# EasyEDA Pro project ProPrj_Smart business cardb_2026-04-14.epro

# Schematic Schematic1
Board Name: Board1; Create Date: 2026-01-03; Page Name: P1; Project Name: Smart business cardb; Schematic Name: Schematic1; Update Date: 2026-01-03; Company: EasyEDA.com; Page Size: A4; Version: V1.0
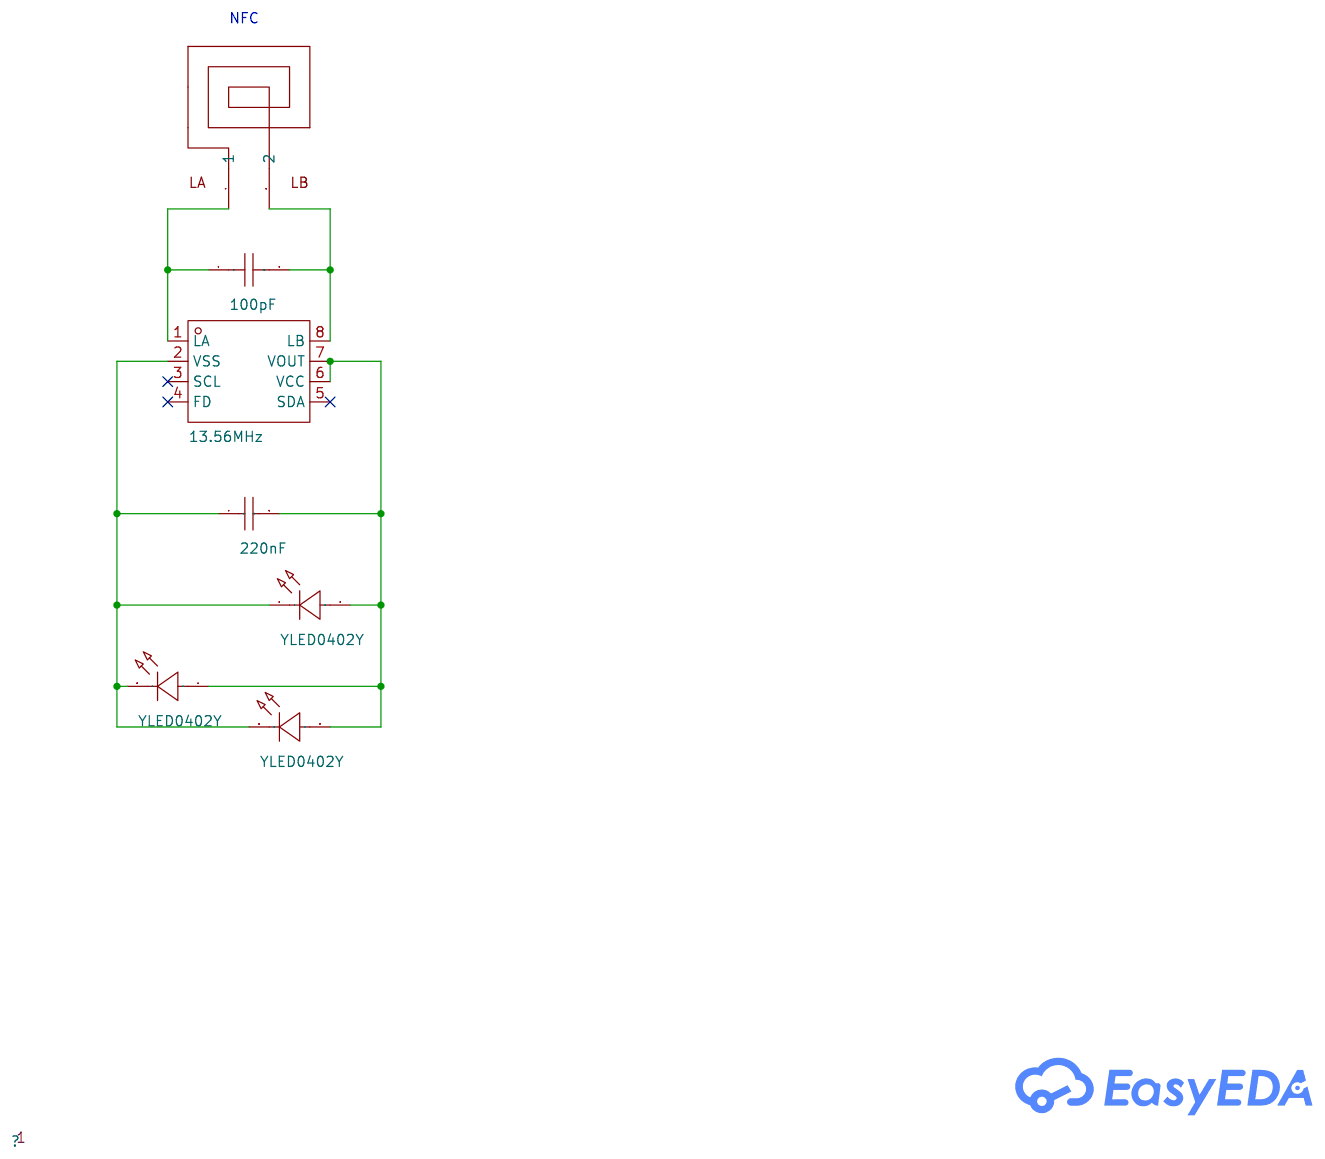
[diagram p0: schematic sheet]

## Parts
C1  220nF  [C0603]
C2  100pF  [C0603]
LED1  YLED0402Y  [LED0402-R-RD]
LED2  YLED0402Y  [LED0402-R-RD]
LED3  YLED0402Y  [LED0402-R-RD]
U3  13.56MHz  [TSSOP-8_L3.0-W3.0-P0.65-LS4.9-BL]
U4  U4  [NFC_ant]

## Library data of the parts
C1 = CL10B224KB8NNNC: Capacitance:220nF Tolerance:±10% Tolerance:±10% Voltage Rating:50V Temperature Coefficient:X7R; LCSC Part Name: 220nF ±10% 50V; Supplier Part: C64705; Manufacturer: SAMSUNG(三星); Supplier Footprint: 0603; JLCPCB Part Class: Extended Part; Datasheet: https://item.szlcsc.com/datasheet/CL10B224KB8NNNC/65773.html; Supplier: LCSC; Tolerance: ±10%; Voltage Rating: 50V; Temperature Coefficient: X7R
C2 = CC0603JRNPO9BN101: Capacitance:100pF Tolerance:±5% Tolerance:±5% Voltage Rating:50V Temperature Coefficient:NP0; LCSC Part Name: 100pF ±5% 50V; Supplier Part: C14665; Manufacturer: YAGEO(国巨); Supplier Footprint: 0603; JLCPCB Part Class: Extended Part; Datasheet: https://item.szlcsc.com/datasheet/CC0603JRNPO9BN101/15333.html; Supplier: LCSC; Tolerance: ±5%; Voltage Rating: 50V; Temperature Coefficient: NP0
LED1-LED3 = YLED0402Y: LCSC Part Name: 发光管; Supplier Part: C20608782; Manufacturer: YONGYUTAI(永裕泰); Supplier Footprint: 0402; JLCPCB Part Class: Extended Part; Datasheet: https://atta.szlcsc.com/upload/public/pdf/source/20240119/E1996C4BAD90A29F1F2A68BBFD6A1841.pdf; Supplier: LCSC
U3 = NT3H2211W0FTTJ: agreement:ISO 14443 interface type:I2C Frequency:13.56MHz Frequency:13.56MHz mains input:3.3V mains input:3.3V; Supplier Part: C2654822; Manufacturer: NXP(恩智浦); Supplier Footprint: TSSOP-8-3mm; JLCPCB Part Class: Extended Part; Datasheet: https://atta.szlcsc.com/upload/public/pdf/source/20211019/1448CB0BFEBB8231D553FFEECD97CF61.pdf; Supplier: LCSC; agreement: ISO 14443; interface type: I2C; mains input: 3.3V
U4 = NFC_business_card_device: https://eds.st.com/antenna/#Turns: 3Antenna Length: 48.6 mmAntenna Width: 40.6 mmConductor Width: 0.6 mmSpacing: 0.6 mmThickness: 35 µmSubstrate Thickness: 1.5 mmRelative Electrical Permittivity (εr): 4.6Equivalent Inductance: @13.56 Mhz 1.01 µH

## Nets
$1N2283: C2.2 U3.8(LB) U4.2
$1N2289: C2.1 U3.1(LA) U4.1
Net-(C1-1): C1.1 LED1.2(K) LED2.2(K) LED3.2(K) U3.2(VSS)
Net-(C1-2): C1.2 LED1.1(A) LED2.1(A) LED3.1(A) U3.6(VCC) U3.7(VOUT)

Not connected (* = marked no-connect by the designer): U3 3(SCL)* 4(FD)* 5(SDA)*

## Notes on the sheet
- NFC

# Board PCB5_1
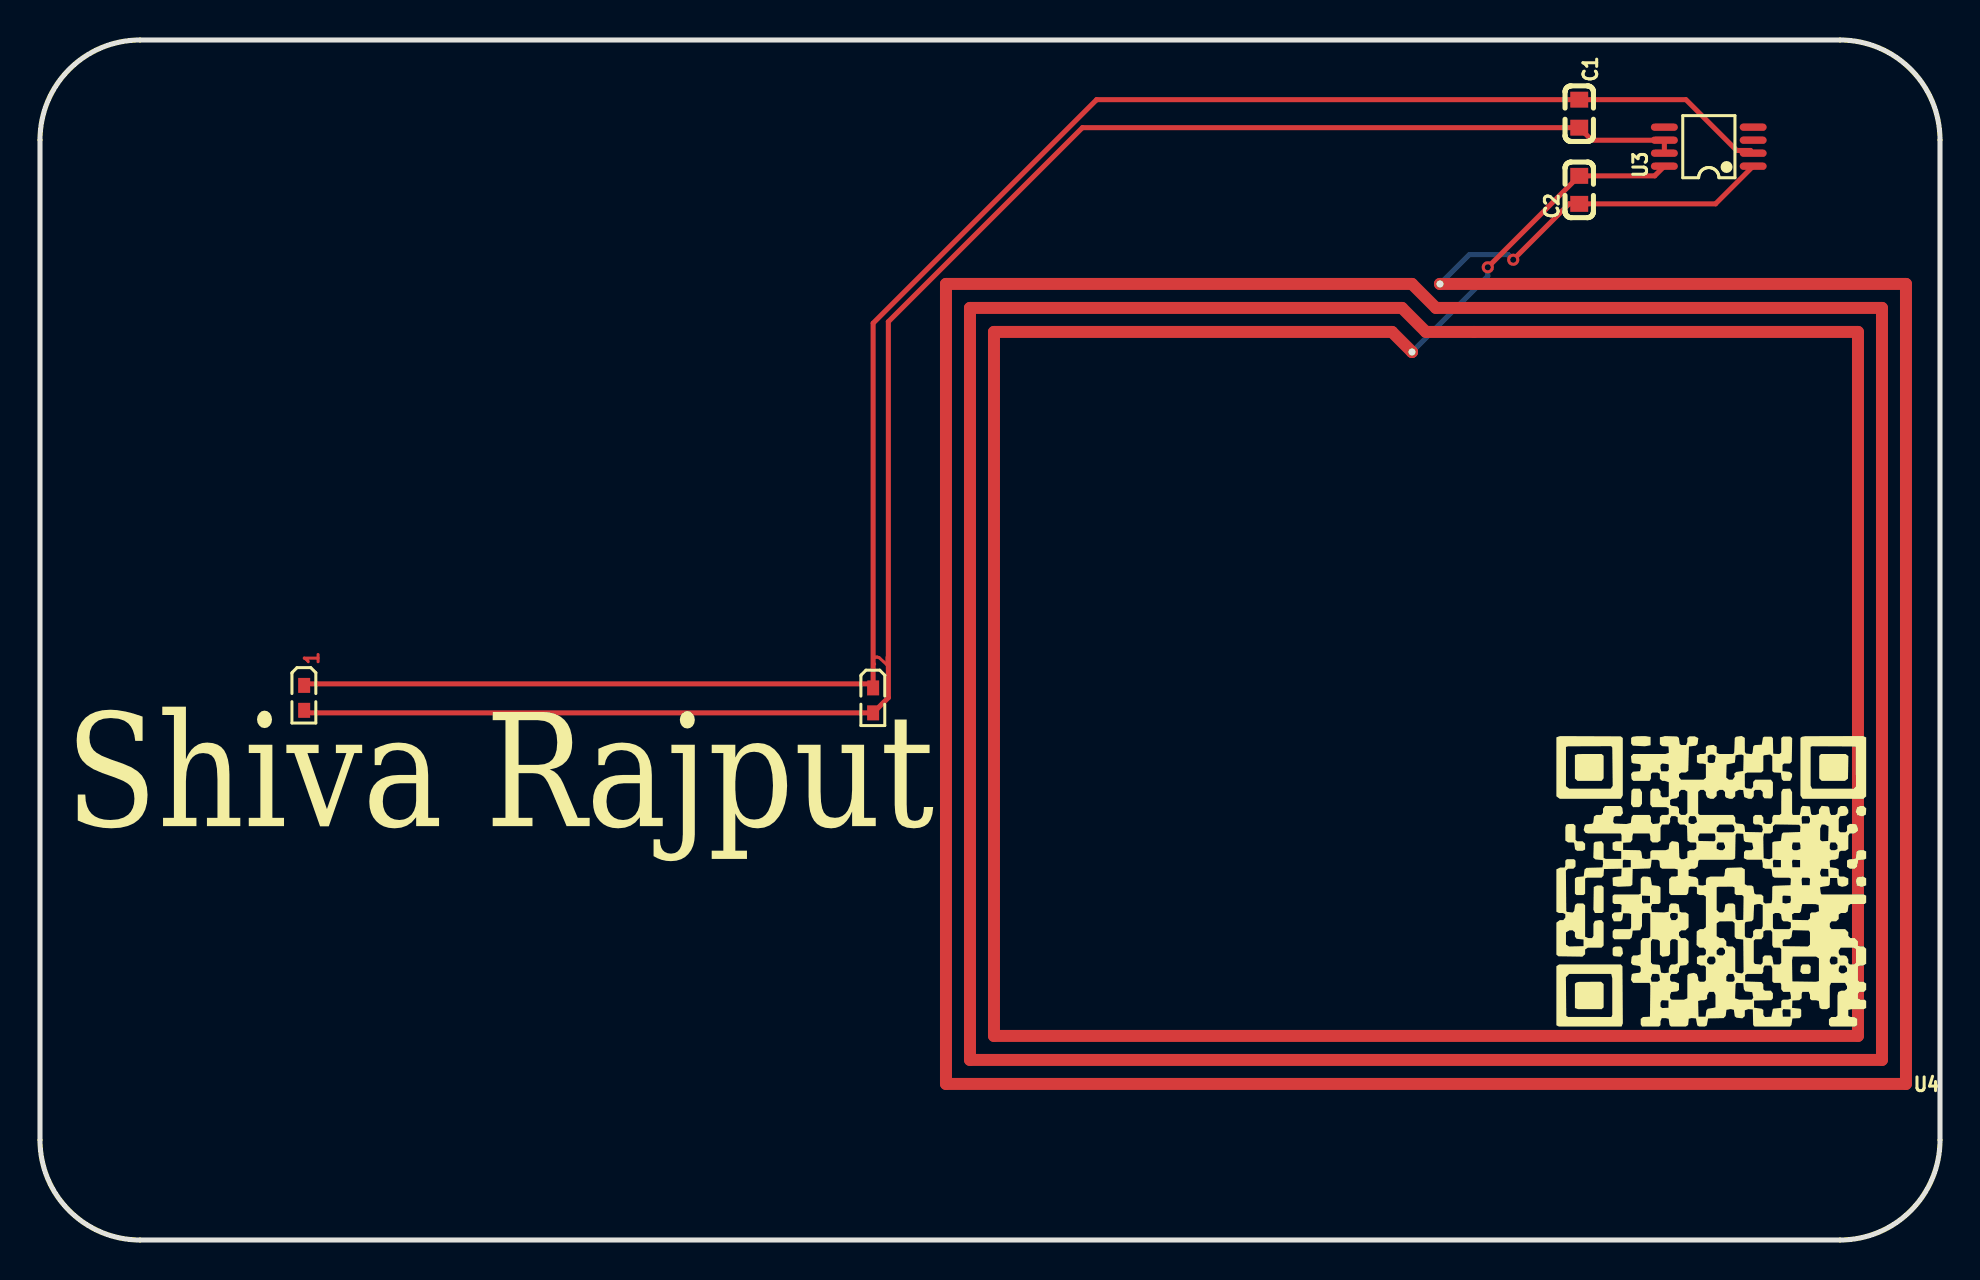
[diagram p1: board, top side]
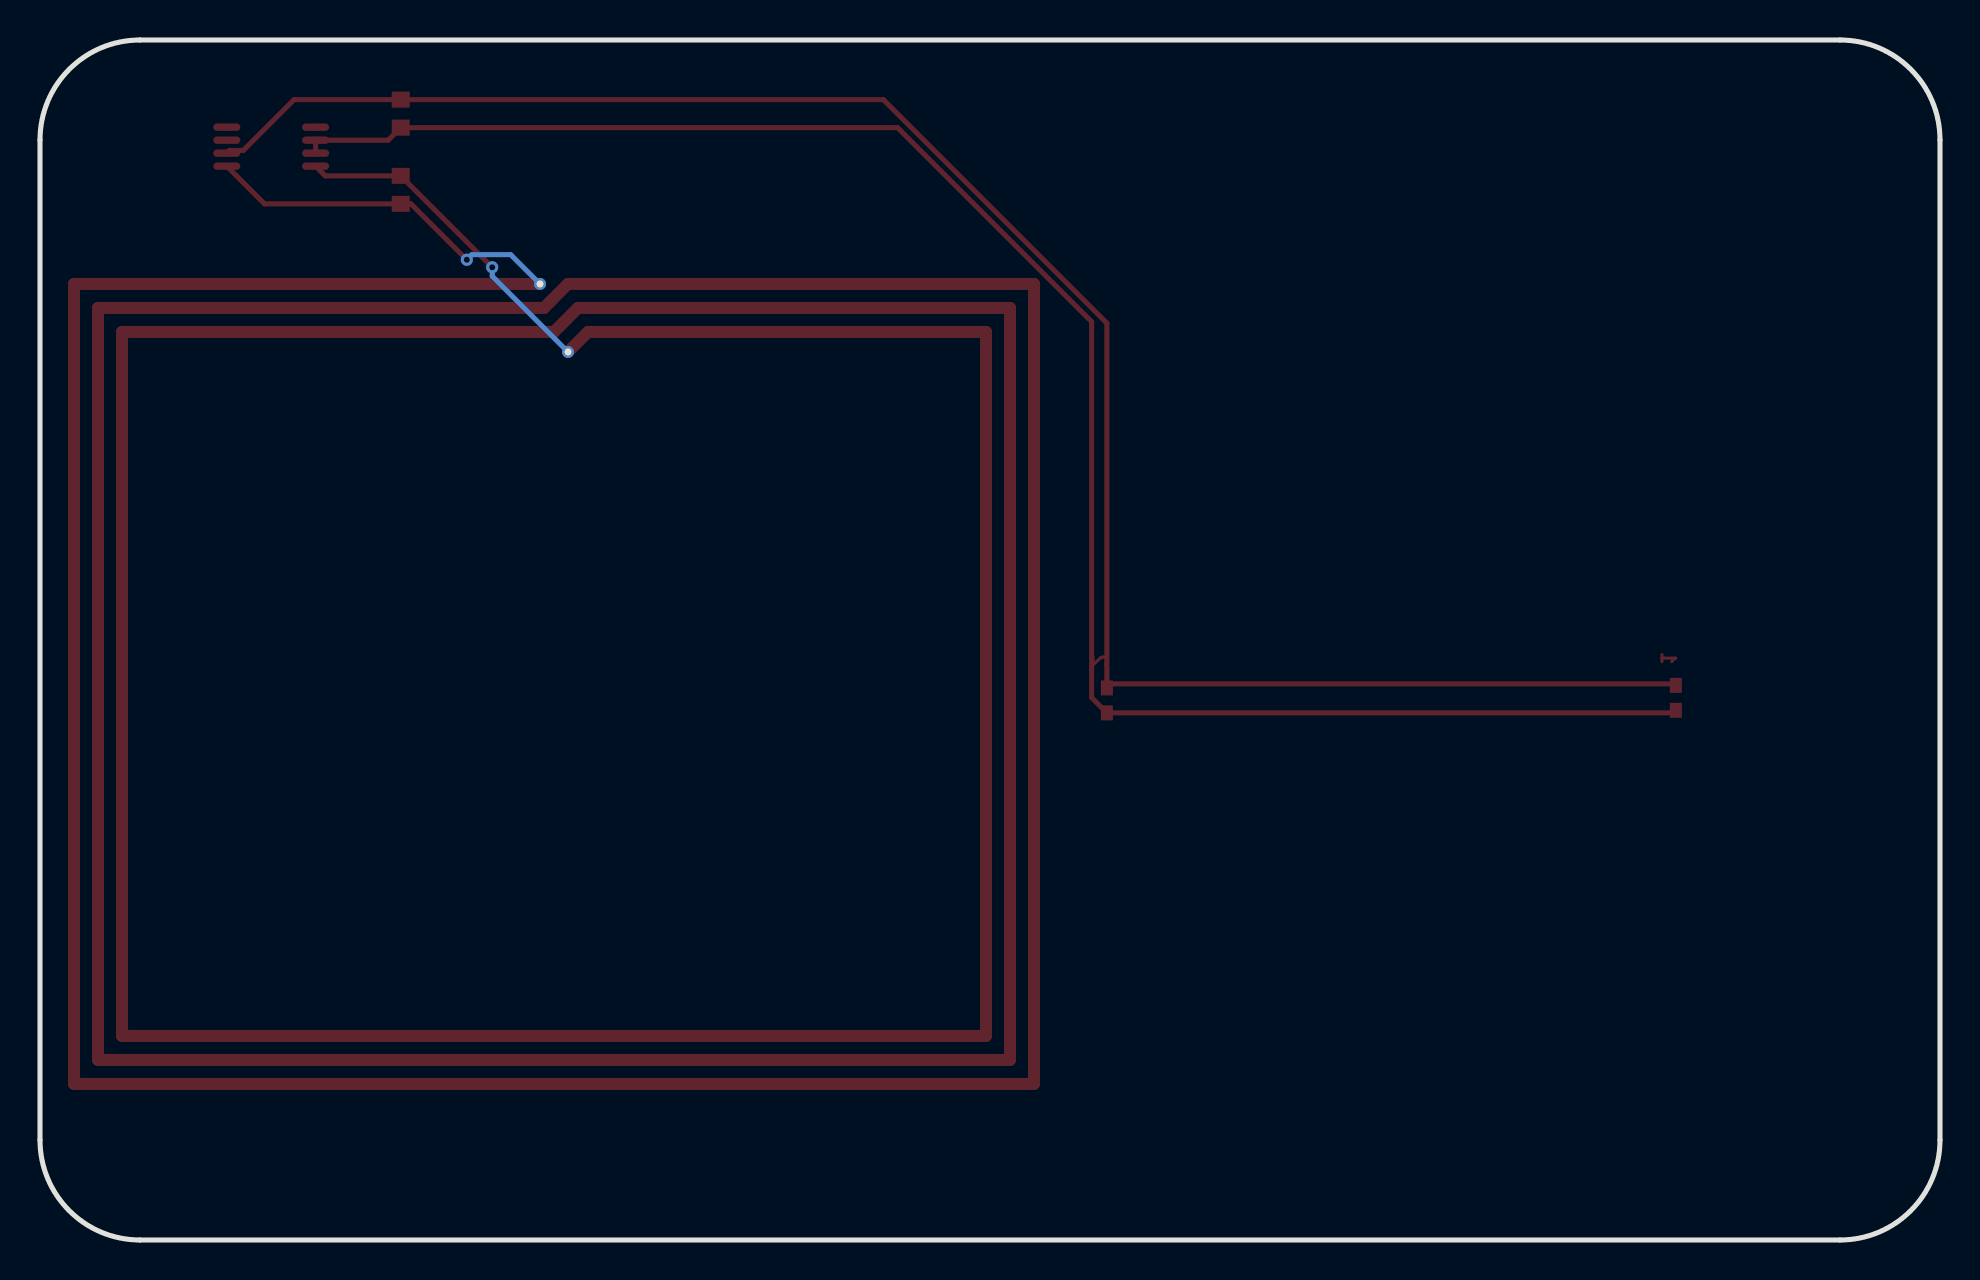
[diagram p2: board, bottom side, seen from below]

Outline 95 x 60 mm; copper layers: Top Layer, Bottom Layer. Coordinates in mm from the lower left corner of the outline.
Outline path: 0,55 0,5 arc(1.46,1.46) 5,0 90,0 arc(93.54,1.46) 95,5 95,55 arc(93.54,58.54) 90,60 5,60 arc(1.46,58.54) 0,55
Stack: Top Layer 0.035mm / Dielectric1 1.51mm FR4 er 4.5 / Bottom Layer 0.035mm

## Design rules (mm)
template: JLCPCB Capability(Two Layers Board)
spacing copperThickness1oz (default): track to track 0.102, other pairs 0.152 to 0.3
spacing copperThickness2oz: track to track 0.203, other pairs 0.152 to 0.3
track width copperThickness1oz (default): min 0.127, default 0.254, max 2.54
track width copperThickness2oz: min 0.203, default 0.254, max 2.54
differential pair differentialPair (default): width min 0.127, default 0.254, max 2.54; gap min 0.152, default 0.152
via viaSize (default): diameter min 0.5, default 0.61, max 10; hole min 0.3, default 0.305, max 6.3

## Placement (name value [footprint] x y rotation side)
1  YLED0402Y  [LED0402-R-RD]  13.21 27.11 270 top
2  YLED0402Y  [LED0402-R-RD]  41.66 26.98 270 top
C1  220nF  [C0603]  76.96 56.32 270 top
C2  100pF  [C0603]  76.96 52.51 90 top
U3  13.56MHz  [TSSOP-8_L3.0-W3.0-P0.65-LS4.9-BL]  83.44 54.67 90 top
U4  U4  [NFC_ant]  93.6 7.8 180 top

## Footprints (pads in the part's own frame, mm; a bottom-side part is the same pattern mirrored in y, then rotated)
C0603
  rect 0.8x0.9 smd: 1(-0.7,0) 2(0.7,0)
LED0402-R-RD
  rect 0.75x0.6 smd: 1(0.623,0) 2(-0.623,0)
NFC_ant
  round 0.6 hole 0.35: 1(23.6,-40) 2(25,-36.6)
TSSOP-8_L3.0-W3.0-P0.65-LS4.9-BL
  oval 0.37x1.35 smd: 1(-0.975,-2.22) 2(-0.325,-2.22) 3(0.325,-2.22) 4(0.975,-2.22) 5(0.975,2.22) 6(0.325,2.22) 7(-0.325,2.22) 8(-0.975,2.22)

## Nets
$1N2283: C2.2 U3.8 U4.2
$1N2289: C2.1 U3.1 U4.1
$1N3505: 1.1 2.1 C1.2 U3.6 U3.7
$1N3515: 1.2 2.2 C1.1 U3.2

Pads without a net: U3 3 4 5

## Via types
v1: diameter 0.61, hole 0.305, Top Layer to Bottom Layer, 2 vias

## Routing (per net, layer and track width the routed paths; a pad name or vN(x,y) marks a point on that pad's centre or on a via; arc(x,y) is an arc through that point)
$1N2283: length 16.7
  Top Layer w0.254: v1(72.39,48.64) C2.2 80.73,53.21 U3.8
  Bottom Layer w0.254: U4.2 72.39,48.19 v1(72.39,48.64)
$1N2289: length 18.3
  Top Layer w0.254: U3.1 83.78,51.81 C2.1 76.45,51.81 v1(73.66,49.01)
  Bottom Layer w0.254: v1(73.66,49.01) 73.41,49.27 71.46,49.27 U4.1
$1N3505: length 92.1
  Top Layer w0.254: U3.7 U3.6 77.59,54.99 C1.2 52.12,55.62 42.42,45.92 42.42,27.12 2.1 13.34,26.36 1.1
$1N3515: length 96.5
  Top Layer w0.254: U3.2 85.52,54.48 84.84,54.48 82.3,57.02 C1.1 52.83,57.02 41.66,45.84 41.66,27.81 ; 1.2 13.29,27.81 41.66,27.81 ; 41.66,27.81 2.2

## Text on the board
Top Solder Mask Layer: www.technologylab.in / mishiva2021@gmail.com / +91 73003-74592
Top Silkscreen Layer: Shiva Rajput

# Board PCB5
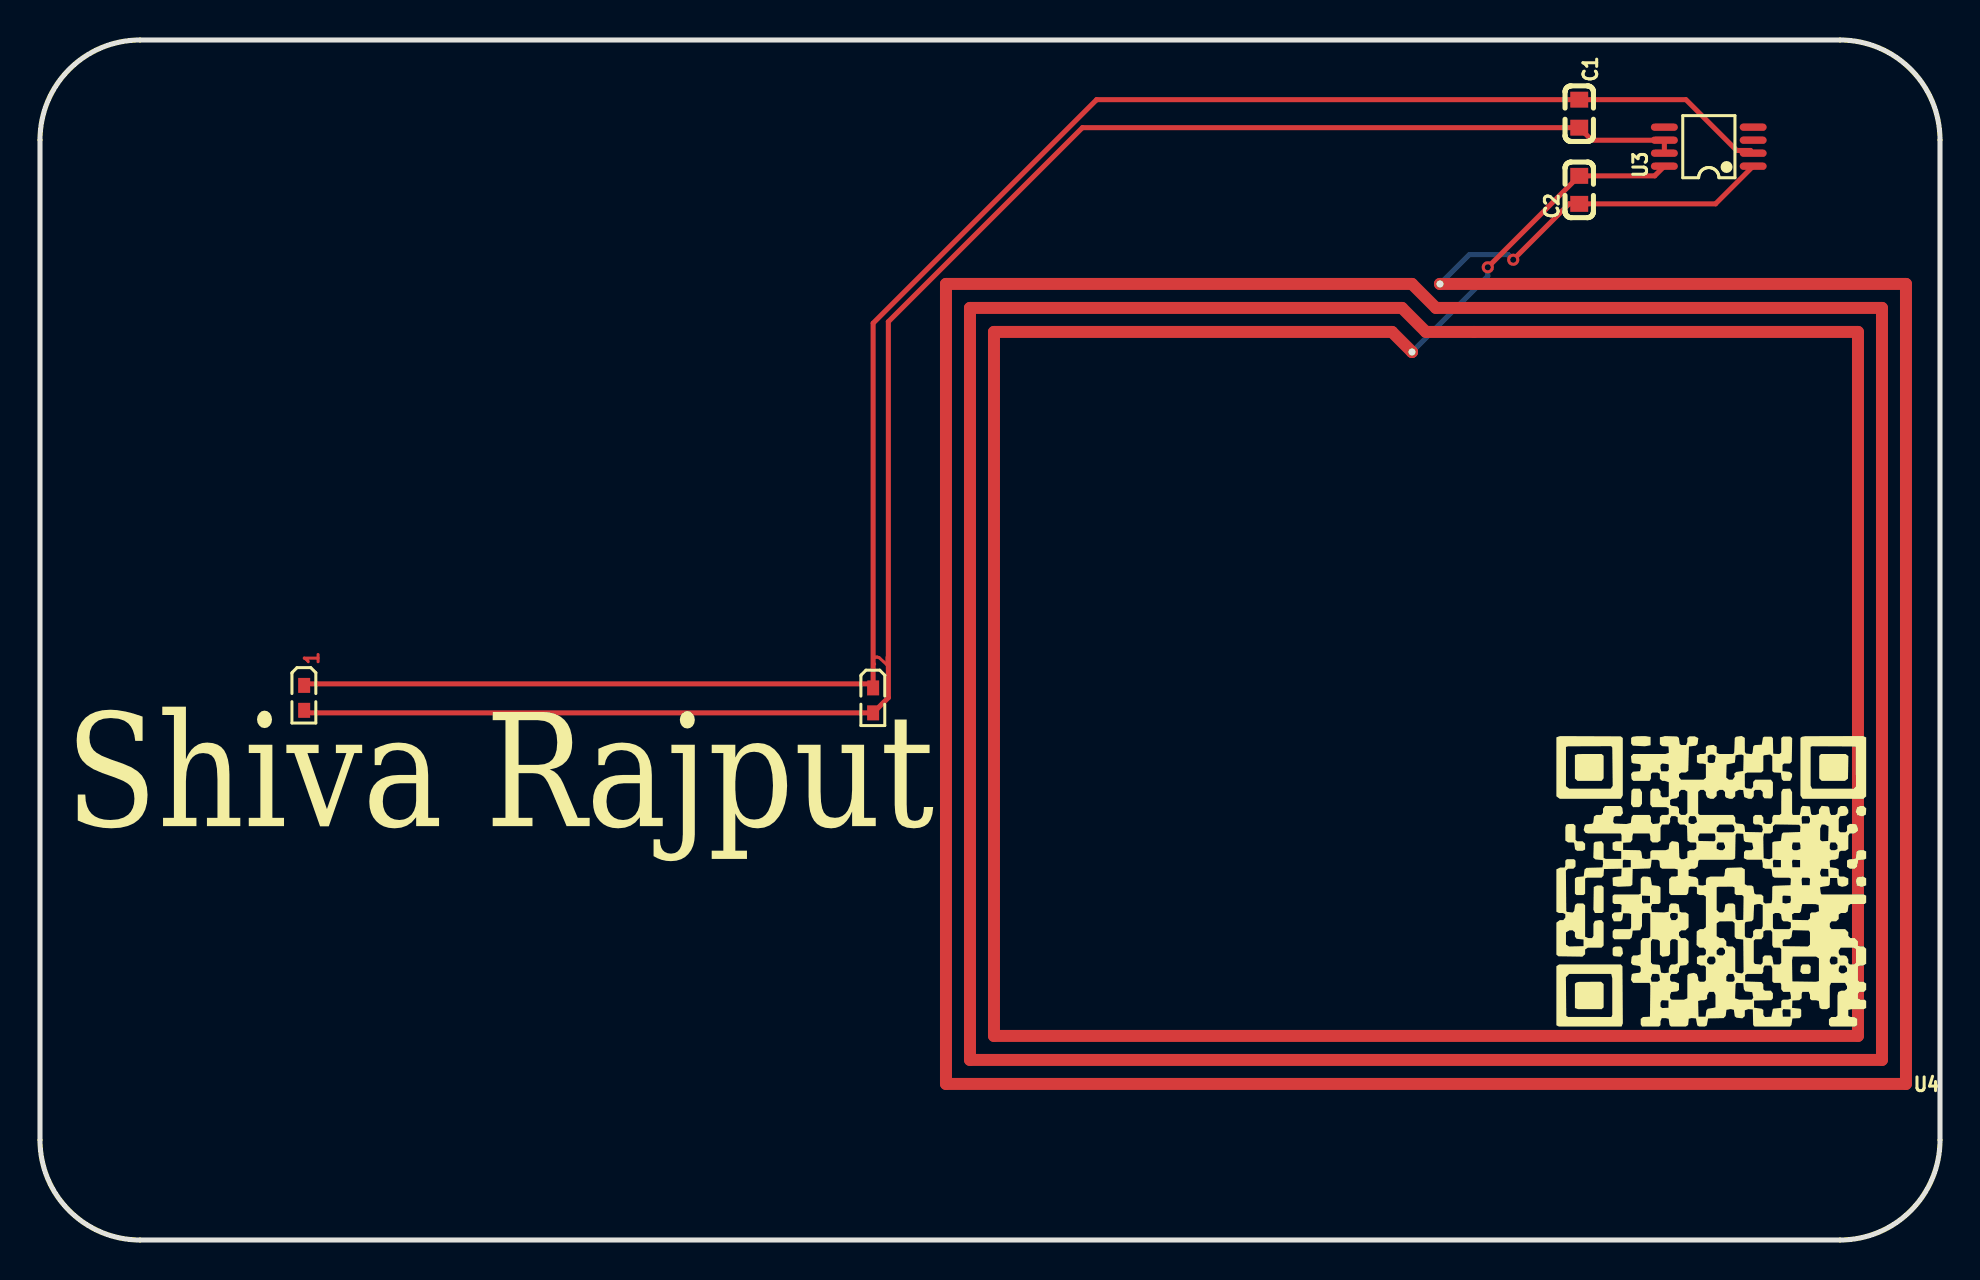
[diagram p3: board, top side]
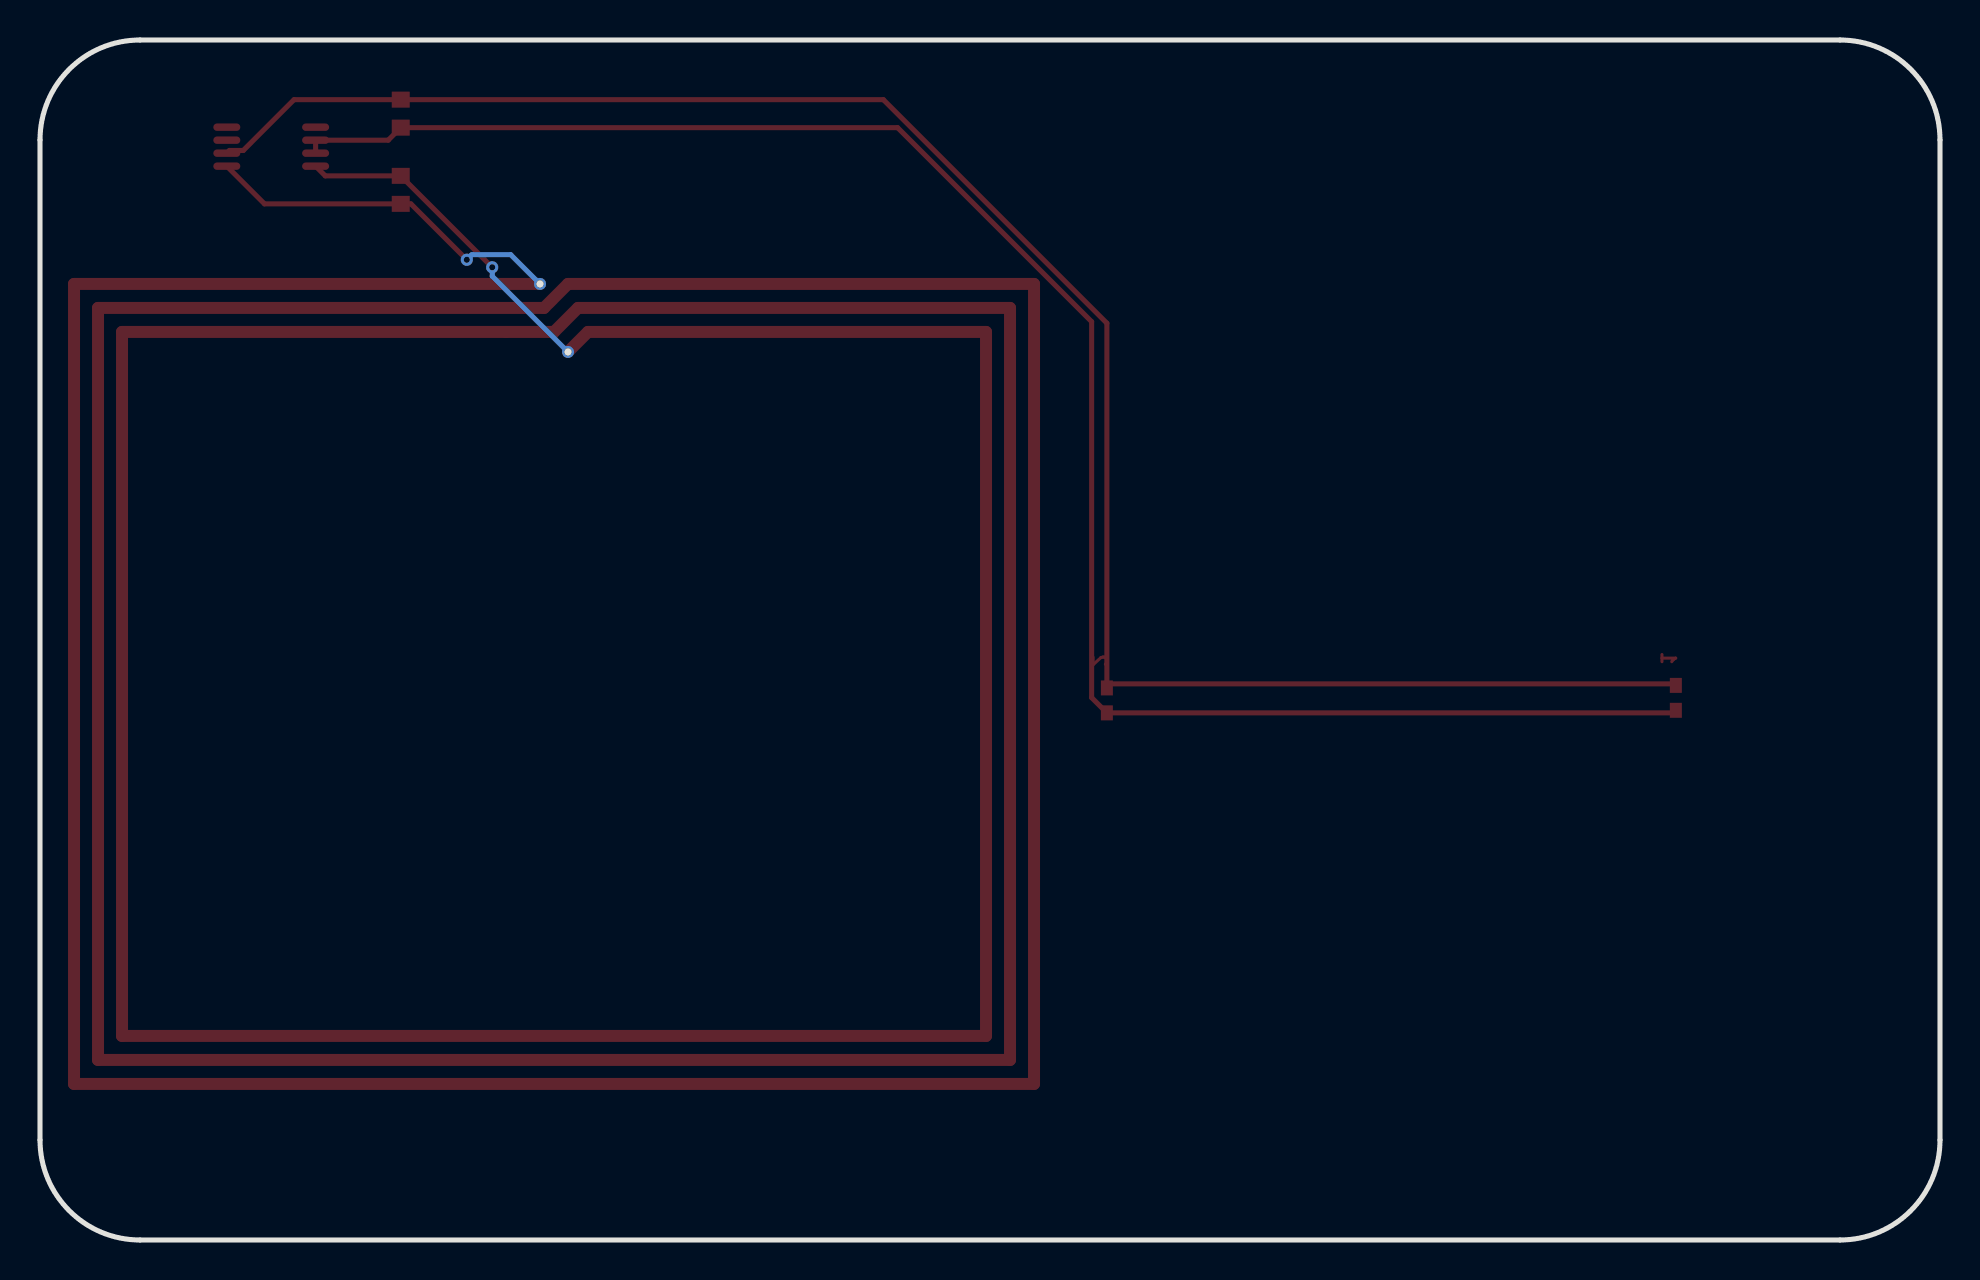
[diagram p4: board, bottom side, seen from below]

Outline 95 x 60 mm; copper layers: Top Layer, Bottom Layer. Coordinates in mm from the lower left corner of the outline.
Outline path: 0,55 0,5 arc(1.46,1.46) 5,0 90,0 arc(93.54,1.46) 95,5 95,55 arc(93.54,58.54) 90,60 5,60 arc(1.46,58.54) 0,55
Stack: Top Layer 0.035mm / Dielectric1 1.51mm FR4 er 4.5 / Bottom Layer 0.035mm

## Design rules (mm)
template: JLCPCB Capability(Two Layers Board)
spacing copperThickness1oz (default): track to track 0.102, other pairs 0.152 to 0.3
spacing copperThickness2oz: track to track 0.203, other pairs 0.152 to 0.3
track width copperThickness1oz (default): min 0.127, default 0.254, max 2.54
track width copperThickness2oz: min 0.203, default 0.254, max 2.54
differential pair differentialPair (default): width min 0.127, default 0.254, max 2.54; gap min 0.152, default 0.152
via viaSize (default): diameter min 0.5, default 0.61, max 10; hole min 0.3, default 0.305, max 6.3

## Placement (name value [footprint] x y rotation side)
1  YLED0402Y  [LED0402-R-RD]  13.21 27.11 270 top
2  YLED0402Y  [LED0402-R-RD]  41.66 26.98 270 top
C1  220nF  [C0603]  76.96 56.32 270 top
C2  100pF  [C0603]  76.96 52.51 90 top
U3  13.56MHz  [TSSOP-8_L3.0-W3.0-P0.65-LS4.9-BL]  83.44 54.67 90 top
U4  U4  [NFC_ant]  93.6 7.8 180 top

## Footprints (pads in the part's own frame, mm; a bottom-side part is the same pattern mirrored in y, then rotated)
C0603
  rect 0.8x0.9 smd: 1(-0.7,0) 2(0.7,0)
LED0402-R-RD
  rect 0.75x0.6 smd: 1(0.623,0) 2(-0.623,0)
NFC_ant
  round 0.6 hole 0.35: 1(23.6,-40) 2(25,-36.6)
TSSOP-8_L3.0-W3.0-P0.65-LS4.9-BL
  oval 0.37x1.35 smd: 1(-0.975,-2.22) 2(-0.325,-2.22) 3(0.325,-2.22) 4(0.975,-2.22) 5(0.975,2.22) 6(0.325,2.22) 7(-0.325,2.22) 8(-0.975,2.22)

## Nets
$1N2283: C2.2 U3.8 U4.2
$1N2289: C2.1 U3.1 U4.1
$1N3505: 1.1 2.1 C1.2 U3.6 U3.7
$1N3515: 1.2 2.2 C1.1 U3.2

Pads without a net: U3 3 4 5

## Via types
v1: diameter 0.61, hole 0.305, Top Layer to Bottom Layer, 2 vias

## Routing (per net, layer and track width the routed paths; a pad name or vN(x,y) marks a point on that pad's centre or on a via; arc(x,y) is an arc through that point)
$1N2283: length 16.7
  Top Layer w0.254: U3.8 80.73,53.21 C2.2 v1(72.39,48.64)
  Bottom Layer w0.254: U4.2 72.39,48.19 v1(72.39,48.64)
$1N2289: length 18.3
  Top Layer w0.254: U3.1 83.78,51.81 C2.1 76.45,51.81 v1(73.66,49.01)
  Bottom Layer w0.254: U4.1 71.46,49.27 73.41,49.27 v1(73.66,49.01)
$1N3505: length 92.1
  Top Layer w0.254: 1.1 13.34,26.36 2.1 42.42,27.12 42.42,45.92 52.12,55.62 C1.2 77.59,54.99 U3.6 U3.7
$1N3515: length 96.5
  Top Layer w0.254: 41.66,27.81 41.66,45.84 52.83,57.02 C1.1 82.3,57.02 84.84,54.48 85.52,54.48 U3.2 ; 41.66,27.81 13.29,27.81 1.2 ; 41.66,27.81 2.2

## Text on the board
Top Solder Mask Layer: www.technologylab.in / mishiva2021@gmail.com / +91 73003-74592
Top Silkscreen Layer: Shiva Rajput
